# EasyEDA Pro project 效果器12-18.eprj, board PCB2
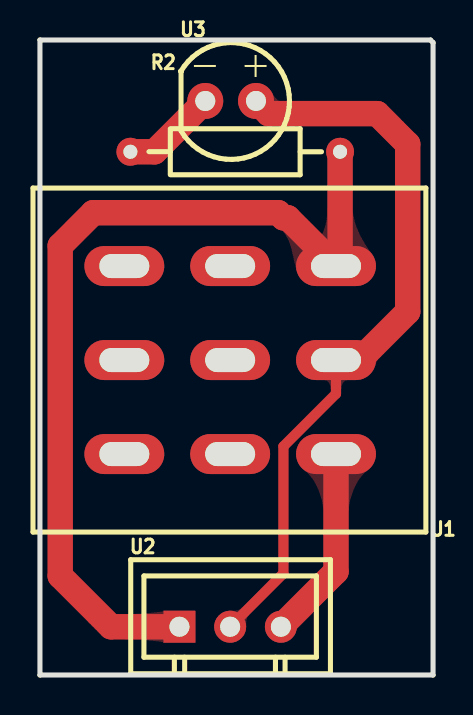
[diagram p10: board, top side]
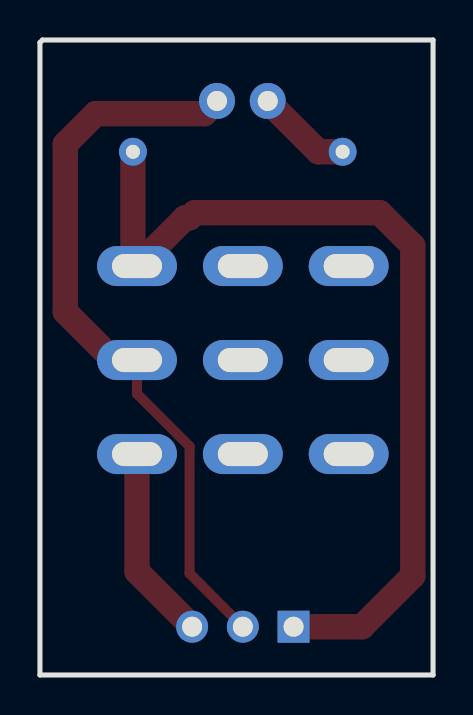
[diagram p11: board, bottom side, seen from below]

Outline 19.69 x 31.75 mm; copper layers: Top Layer, Bottom Layer. Coordinates in mm from the lower left corner of the outline.
Outline path: 0,31.75 19.56,31.75 19.69,31.62 19.69,0 0,0 0,31.75
Stack: Top Layer 0.035mm / Dielectric1 1.51mm FR4 er 4.5 / Bottom Layer 0.035mm

## Design rules (mm)
template: JLCPCB Capability(Two Layers Board)
spacing copperThickness1oz (default): track to track 0.102, other pairs 0.152 to 0.3
spacing copperThickness2oz: track to track 0.203, other pairs 0.152 to 0.3
track width copperThickness1oz (default): min 0.127, default 0.254, max 2.54
track width copperThickness2oz: min 0.203, default 0.254, max 2.54
differential pair differentialPair (default): width min 0.127, default 0.254, max 2.54; gap min 0.152, default 0.152
via viaSize (default): diameter min 0.5, default 0.61, max 10; hole min 0.3, default 0.305, max 6.3

## Placement (name value [footprint] x y rotation side)
R2  1kΩ  [RES-TH_BD2.3-L6.5-P10.50-D0.5]  9.78 26.16 180 top
U1  -  [踩钉封装]  9.53 15.75 180 top
U2  ZX-XH2.54-3PZZ  [CONN-TH_3P-P2.54_2501S-3P]  9.53 2.41 0 top
U3  LTL-307E  [LED-TH_BD5.9-P2.54-RD_RED]  9.55 28.7 0 top

## Footprints (pads in the part's own frame, mm; a bottom-side part is the same pattern mirrored in y, then rotated)
CONN-TH_3P-P2.54_2501S-3P
  rect 1.6x1.6 hole 1: 1(-2.54,0)
  round 1.6 hole 1: 2(0,0) 3(2.54,0)
LED-TH_BD5.9-P2.54-RD_RED
  round 1.8 hole 1: 1(-1.27,0) 2(1.27,0)
RES-TH_BD2.3-L6.5-P10.50-D0.5
  round 1.4 hole 0.7: 1(-5.25,0) 2(5.25,0)
踩钉封装
  oval 4x2 hole 2.5x1.2: 1(-5.3,4.7) 2(-5.3,0) 3(-5.3,-4.7) 4(0,4.7) 5(0,0) 6(0,-4.7) 7(5.3,4.7) 8(5.3,0) 9(5.3,-4.7)

## Nets
As in the schematic.

Pads without a net: U1 5 6 7 8 9

## Routing (per net, layer and track width the routed paths; a pad name or vN(x,y) marks a point on that pad's centre or on a via; arc(x,y) is an arc through that point)
GND: length 44.9
  Top Layer w1.27: U2.1 3.56,2.41 1.02,4.95 1.02,21.46 2.67,23.11 11.94,23.11 12.19,22.86 12.41,22.86 U1.3 15.03,20.65 R2.1
VCC: length 9.8
  Top Layer w1.27: U2.3 14.83,5.17 U1.1
$1N296: length 37
  Top Layer w0.508: U2.2 12.19,5.08 12.19,11.43 14.83,14.06 U1.2
  Top Layer w1.27: U3.2 11.45,28.07 16.89,28.07 18.41,26.54 18.41,18.16 16,15.75 U1.2
$1N557: length 4.8
  Top Layer w1.27: R2.2 5.74,26.16 U3.1

Small or netless copper shapes (teardrops, artwork), in the pictures only: 10 on Top Layer
